# Altium schematic sheet GridSeed.SchDoc (part 1 of 2)
size A0; DocumentNumber: 1; SheetNumber: 1; SheetTotal: 1; SheetSize: A3
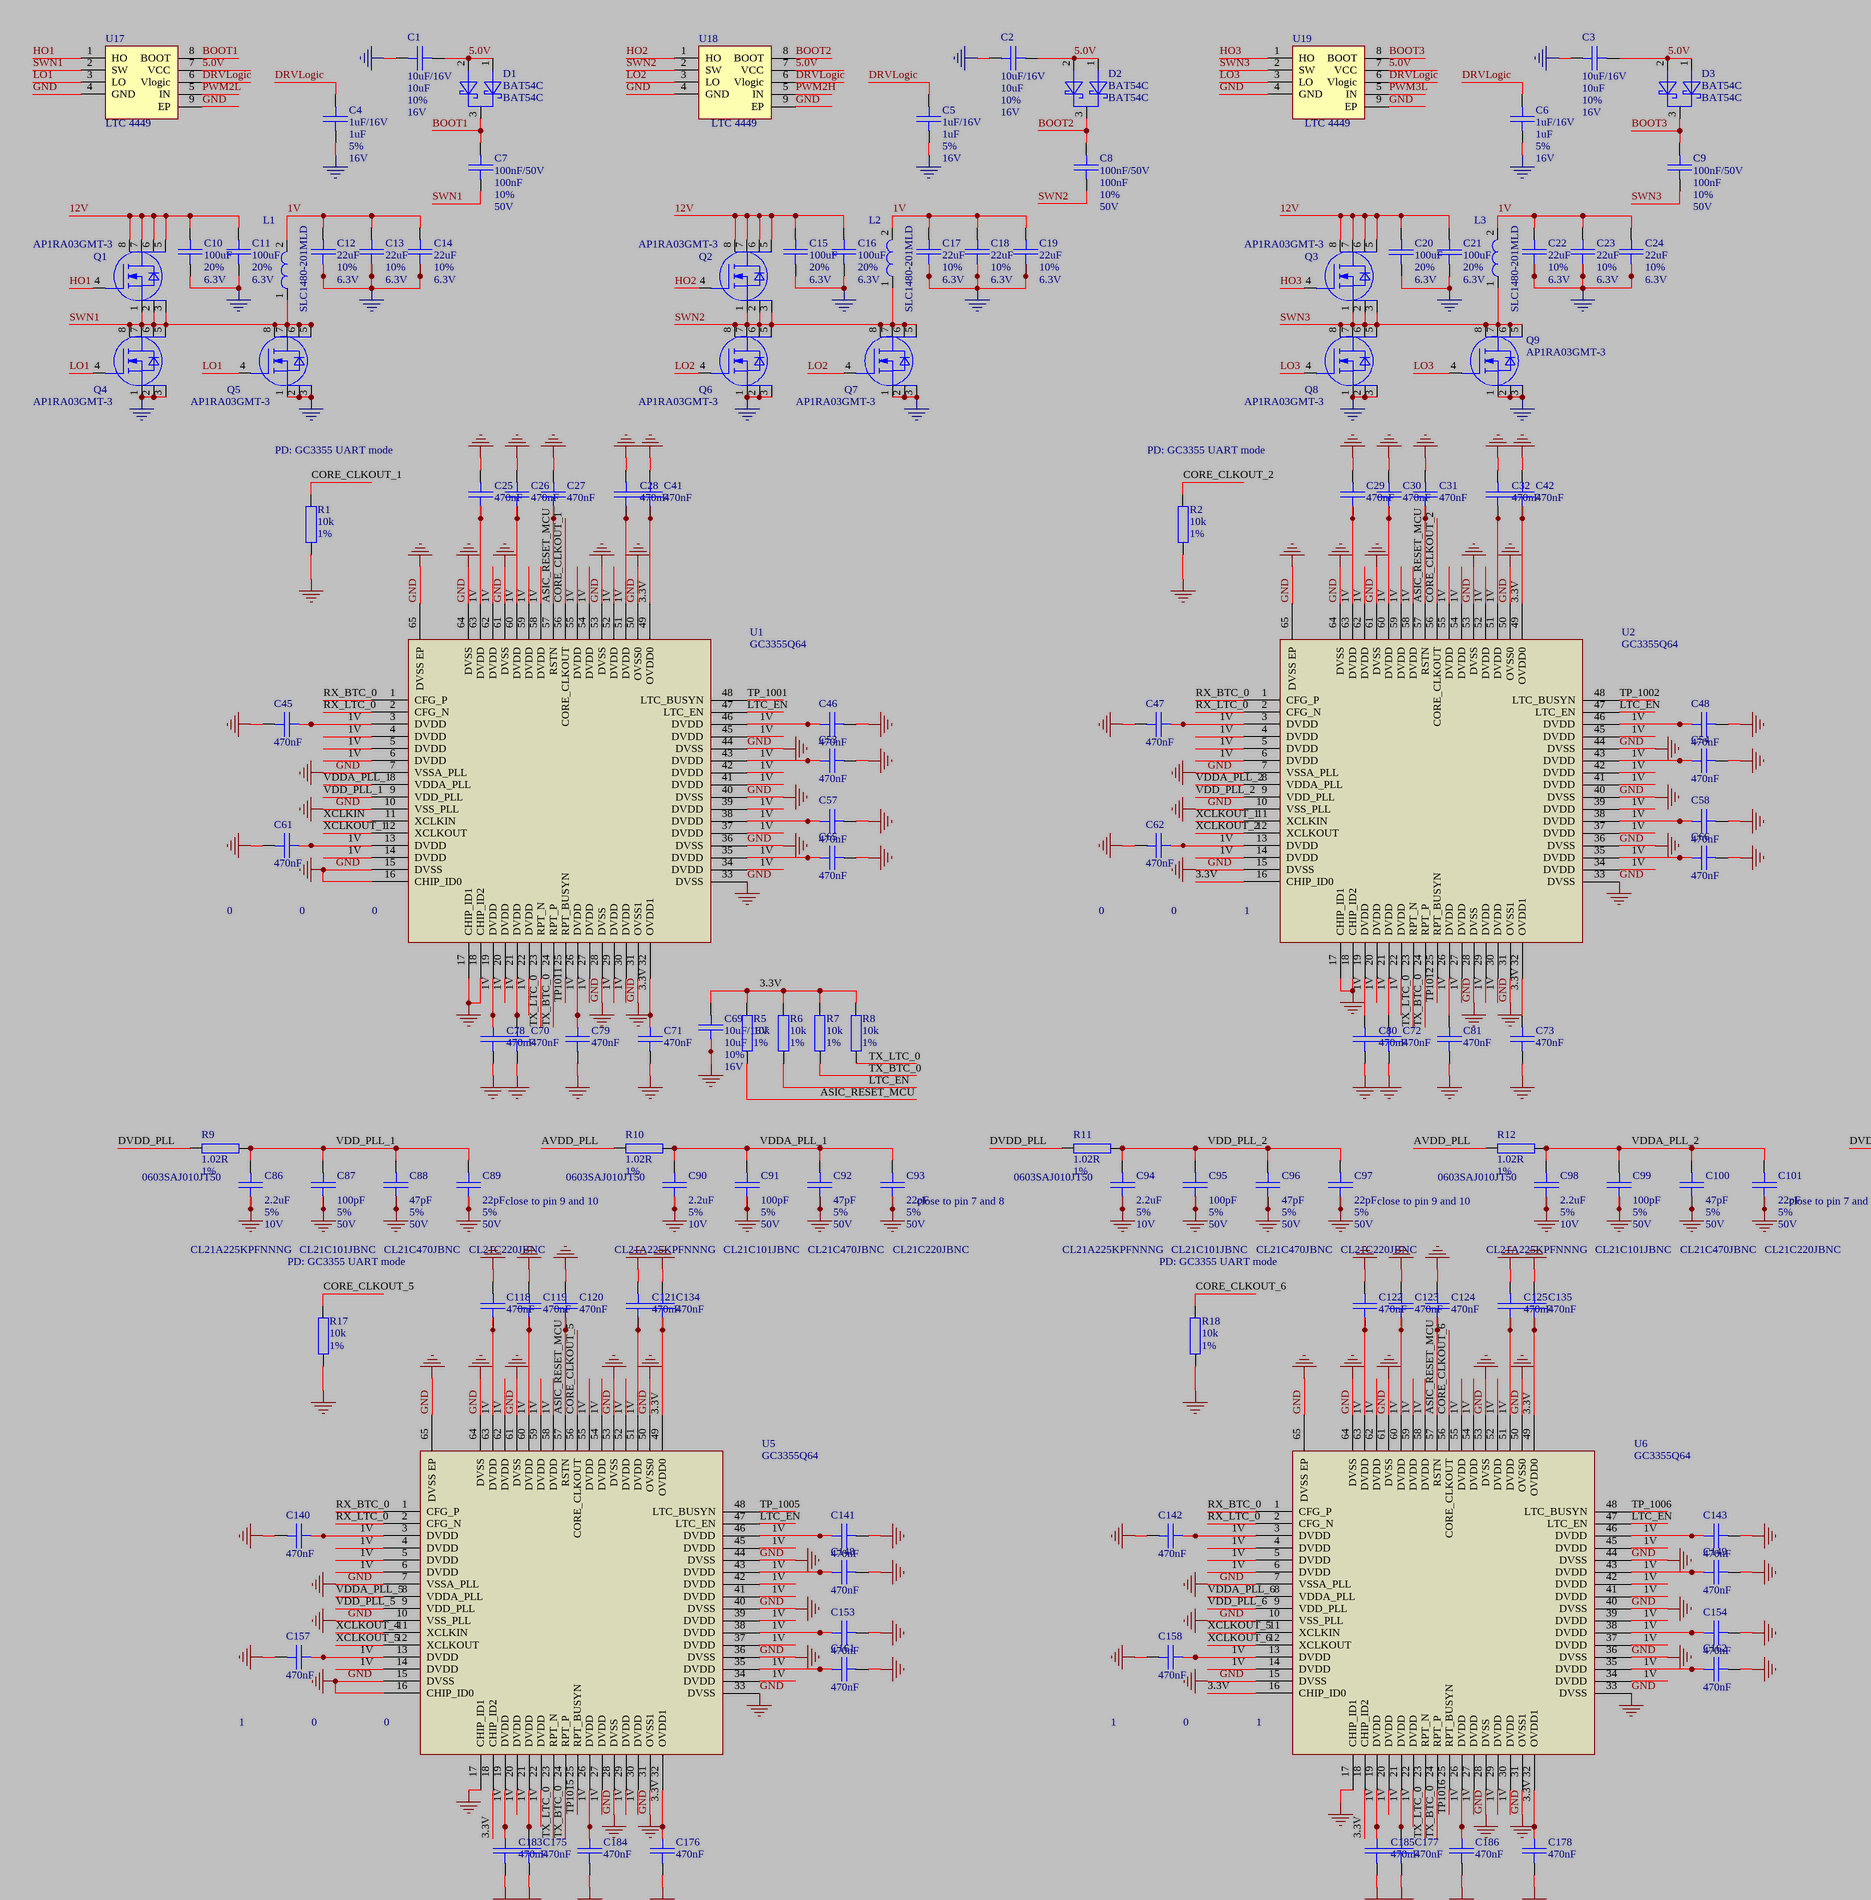
[diagram p0: GridSeed.SchDoc, top left]
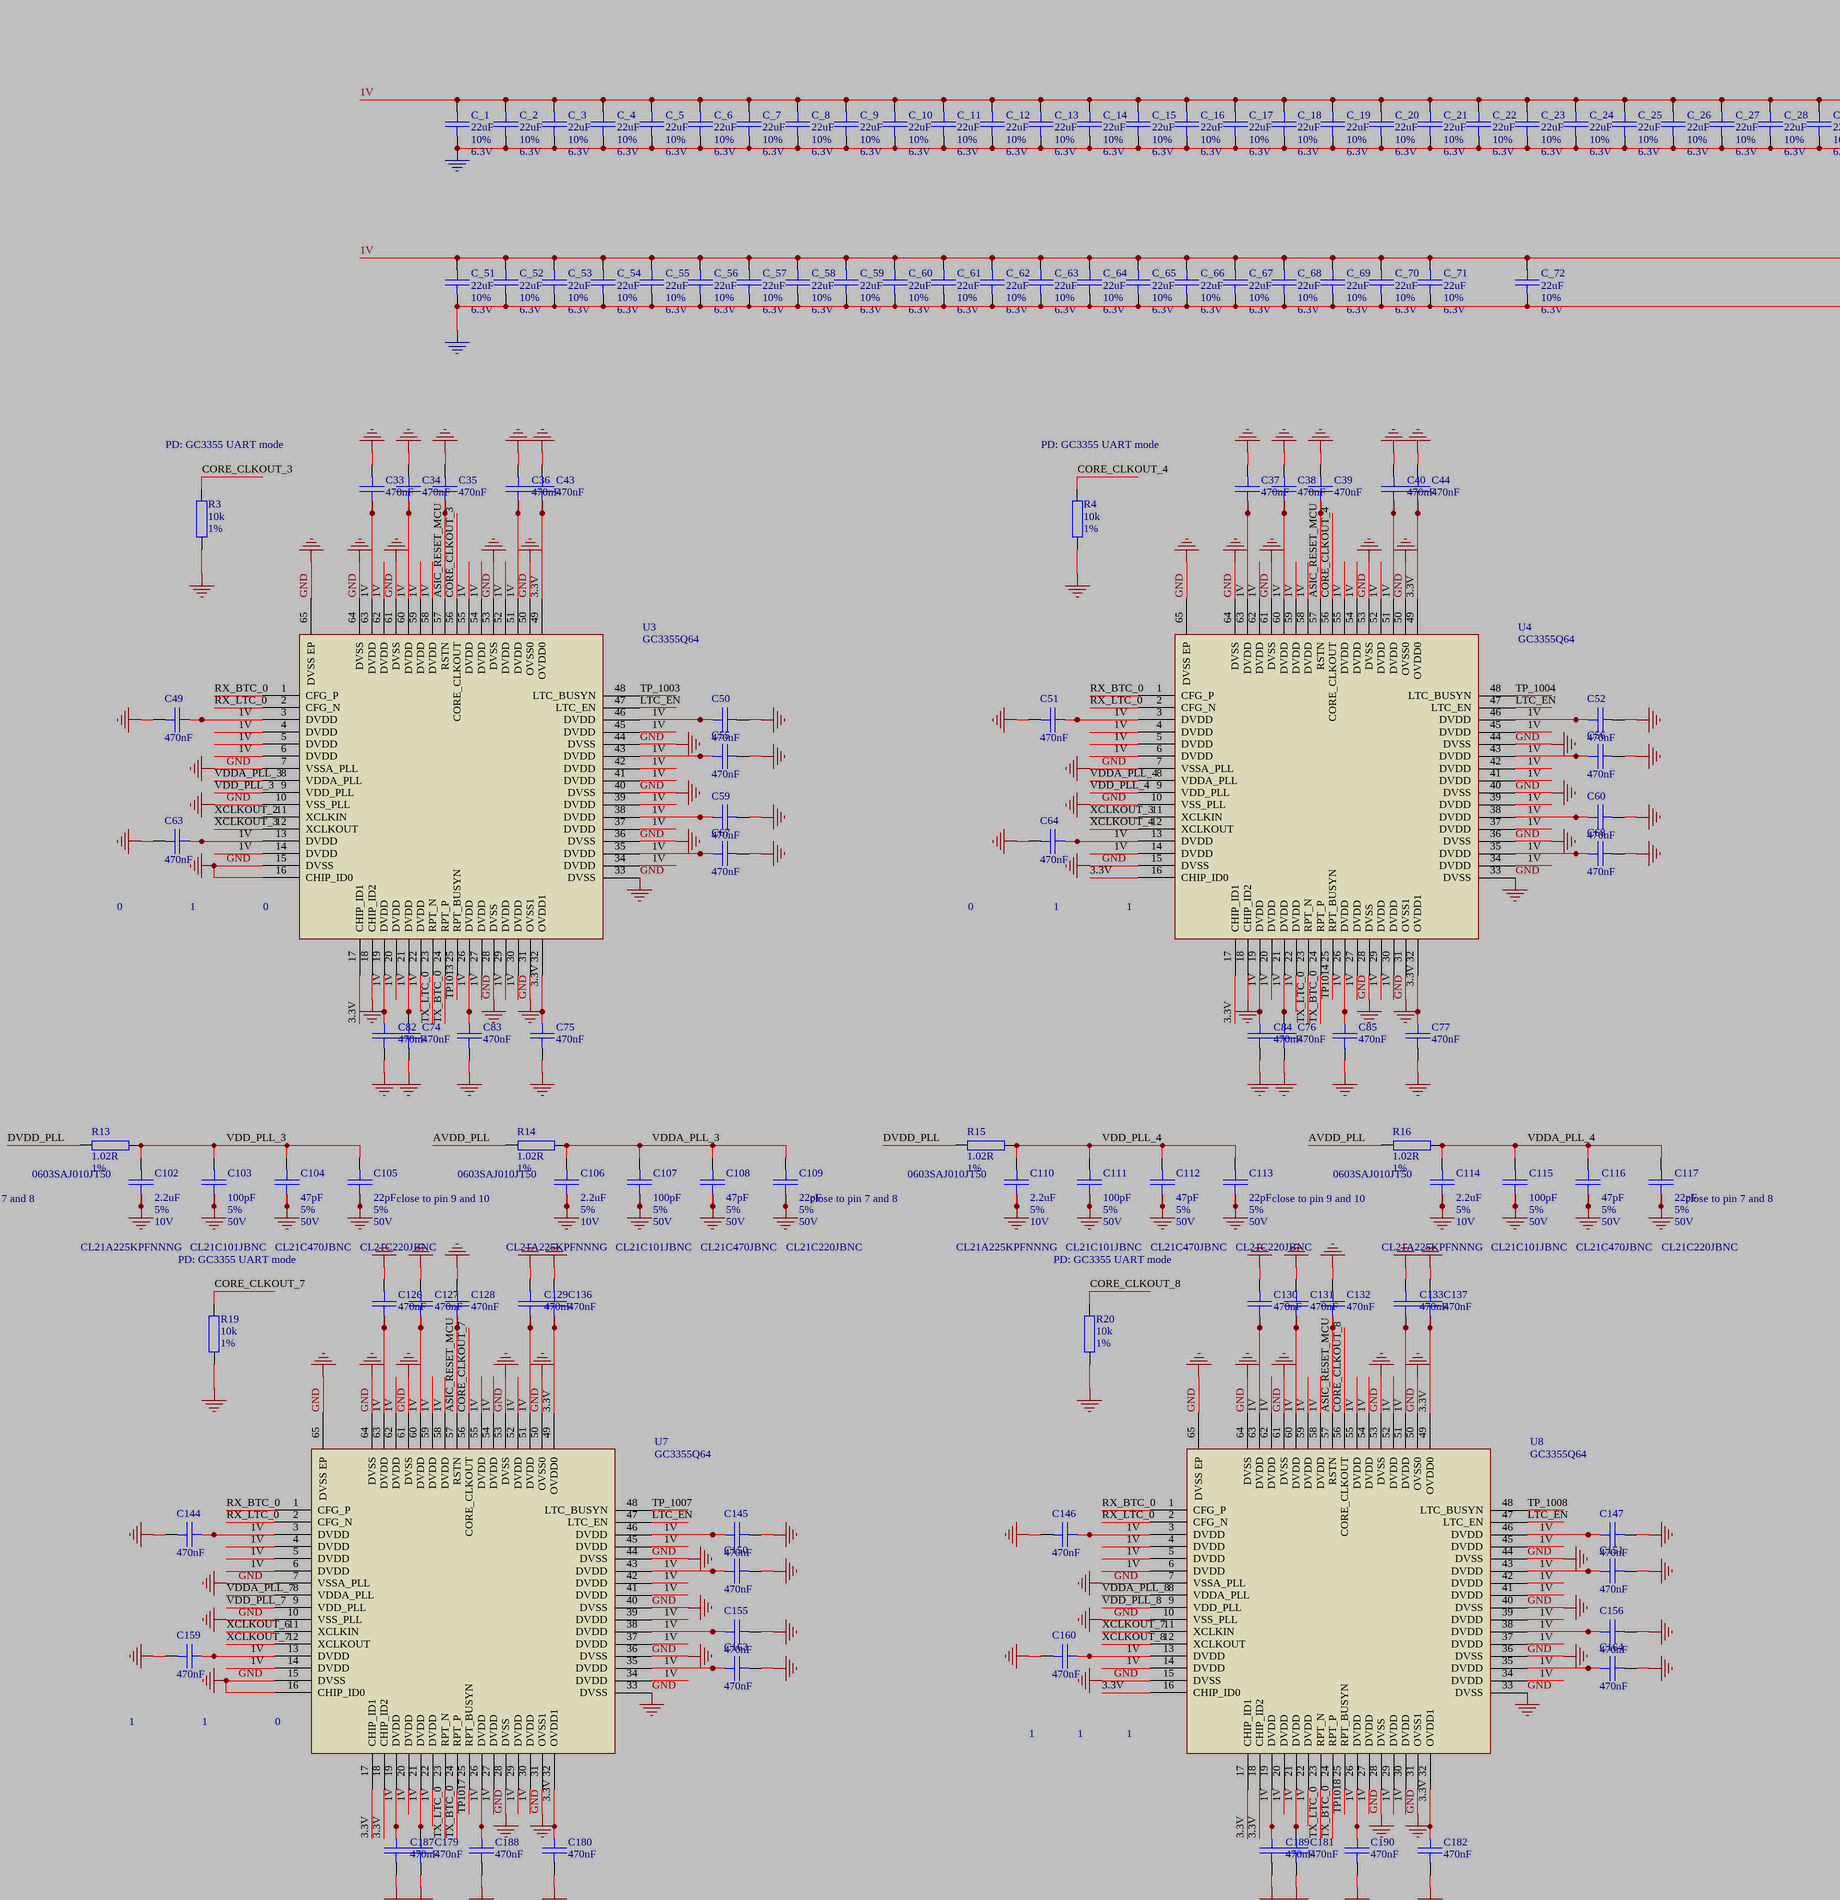
[diagram p1: GridSeed.SchDoc, top middle]
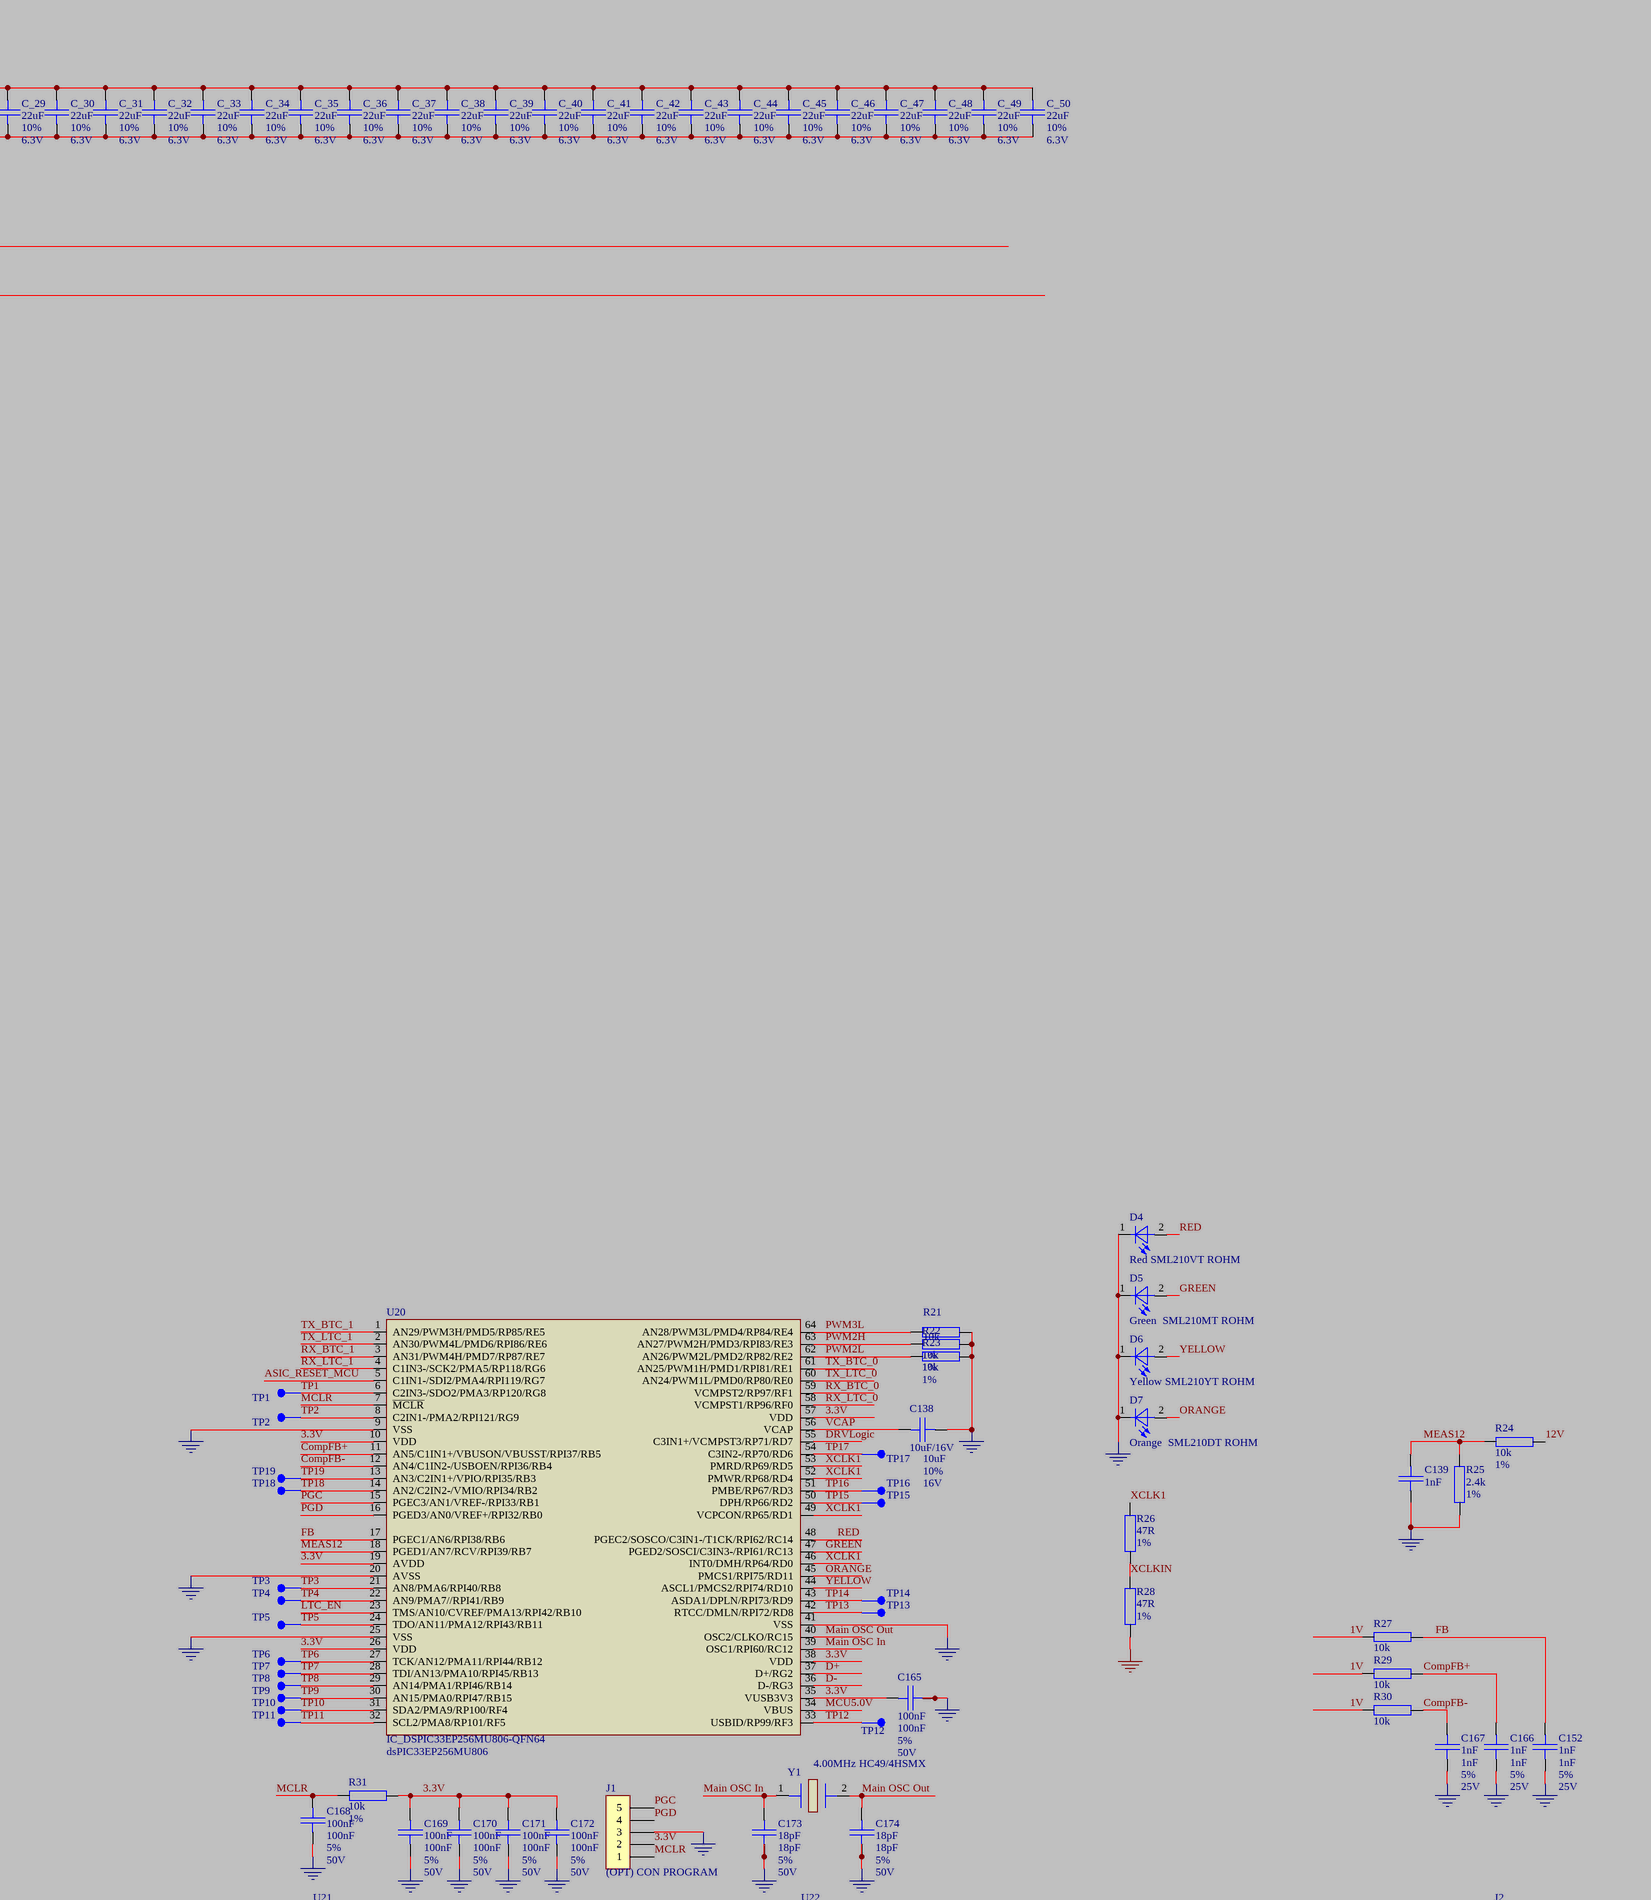
[diagram p2: GridSeed.SchDoc, top right]
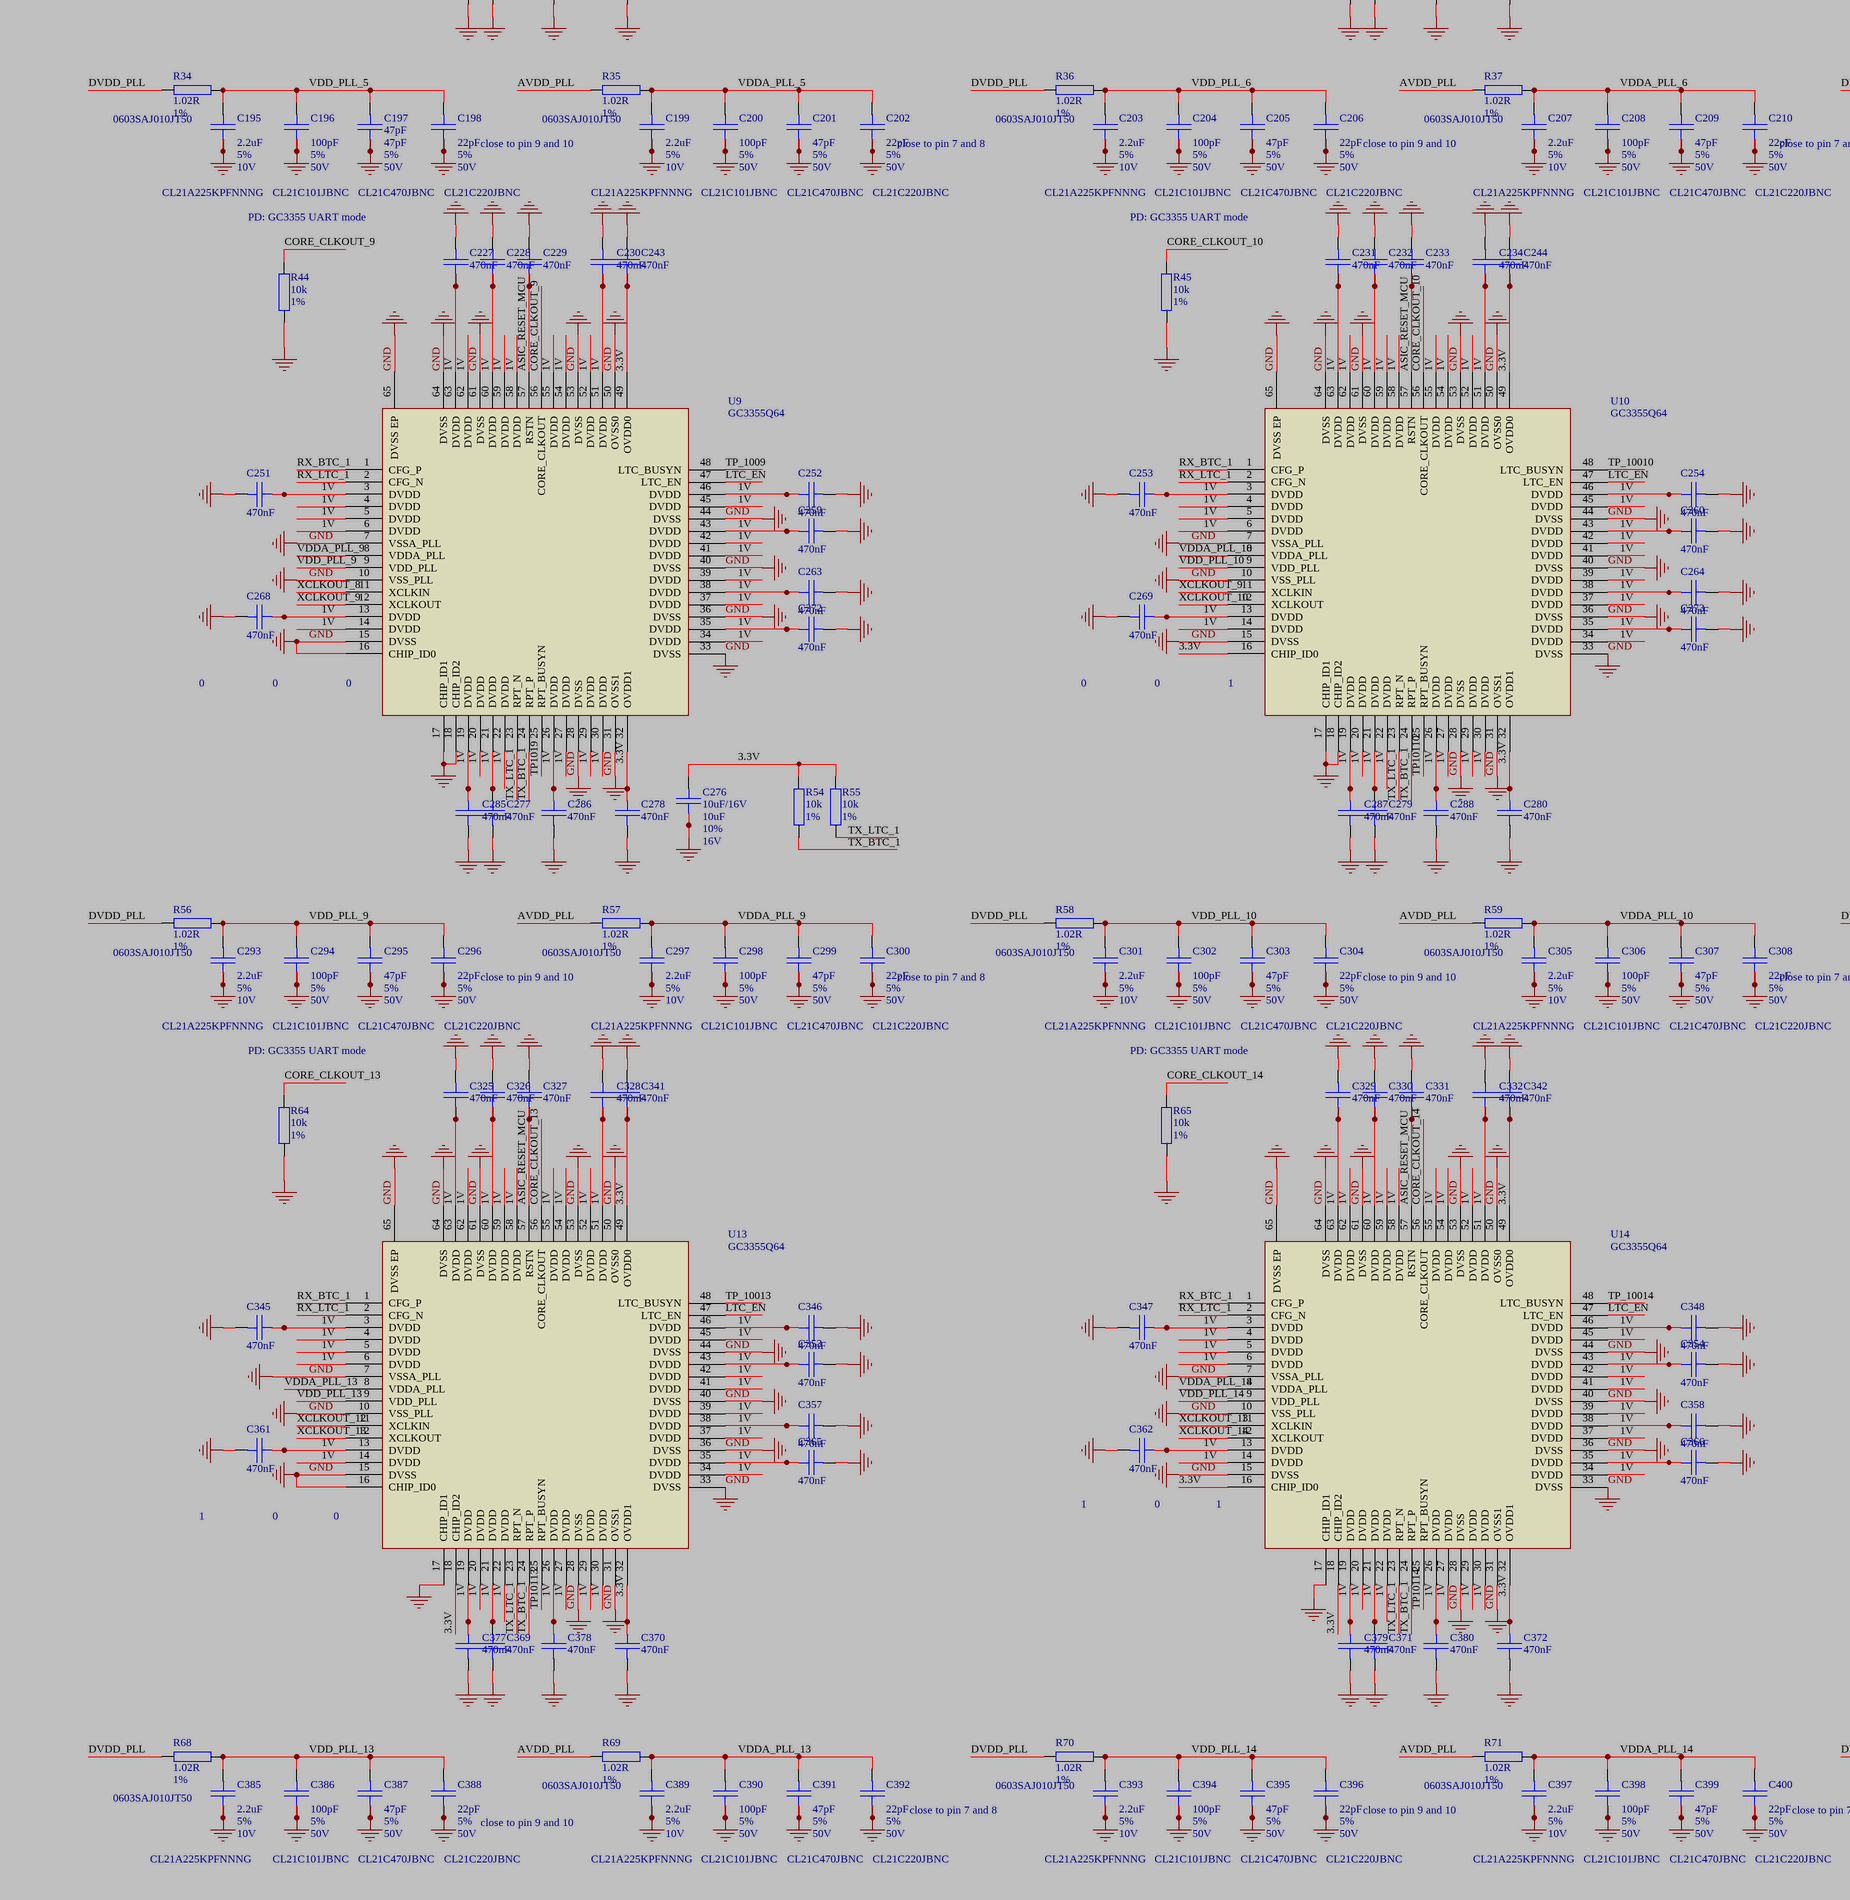
[diagram p3: GridSeed.SchDoc, bottom left]
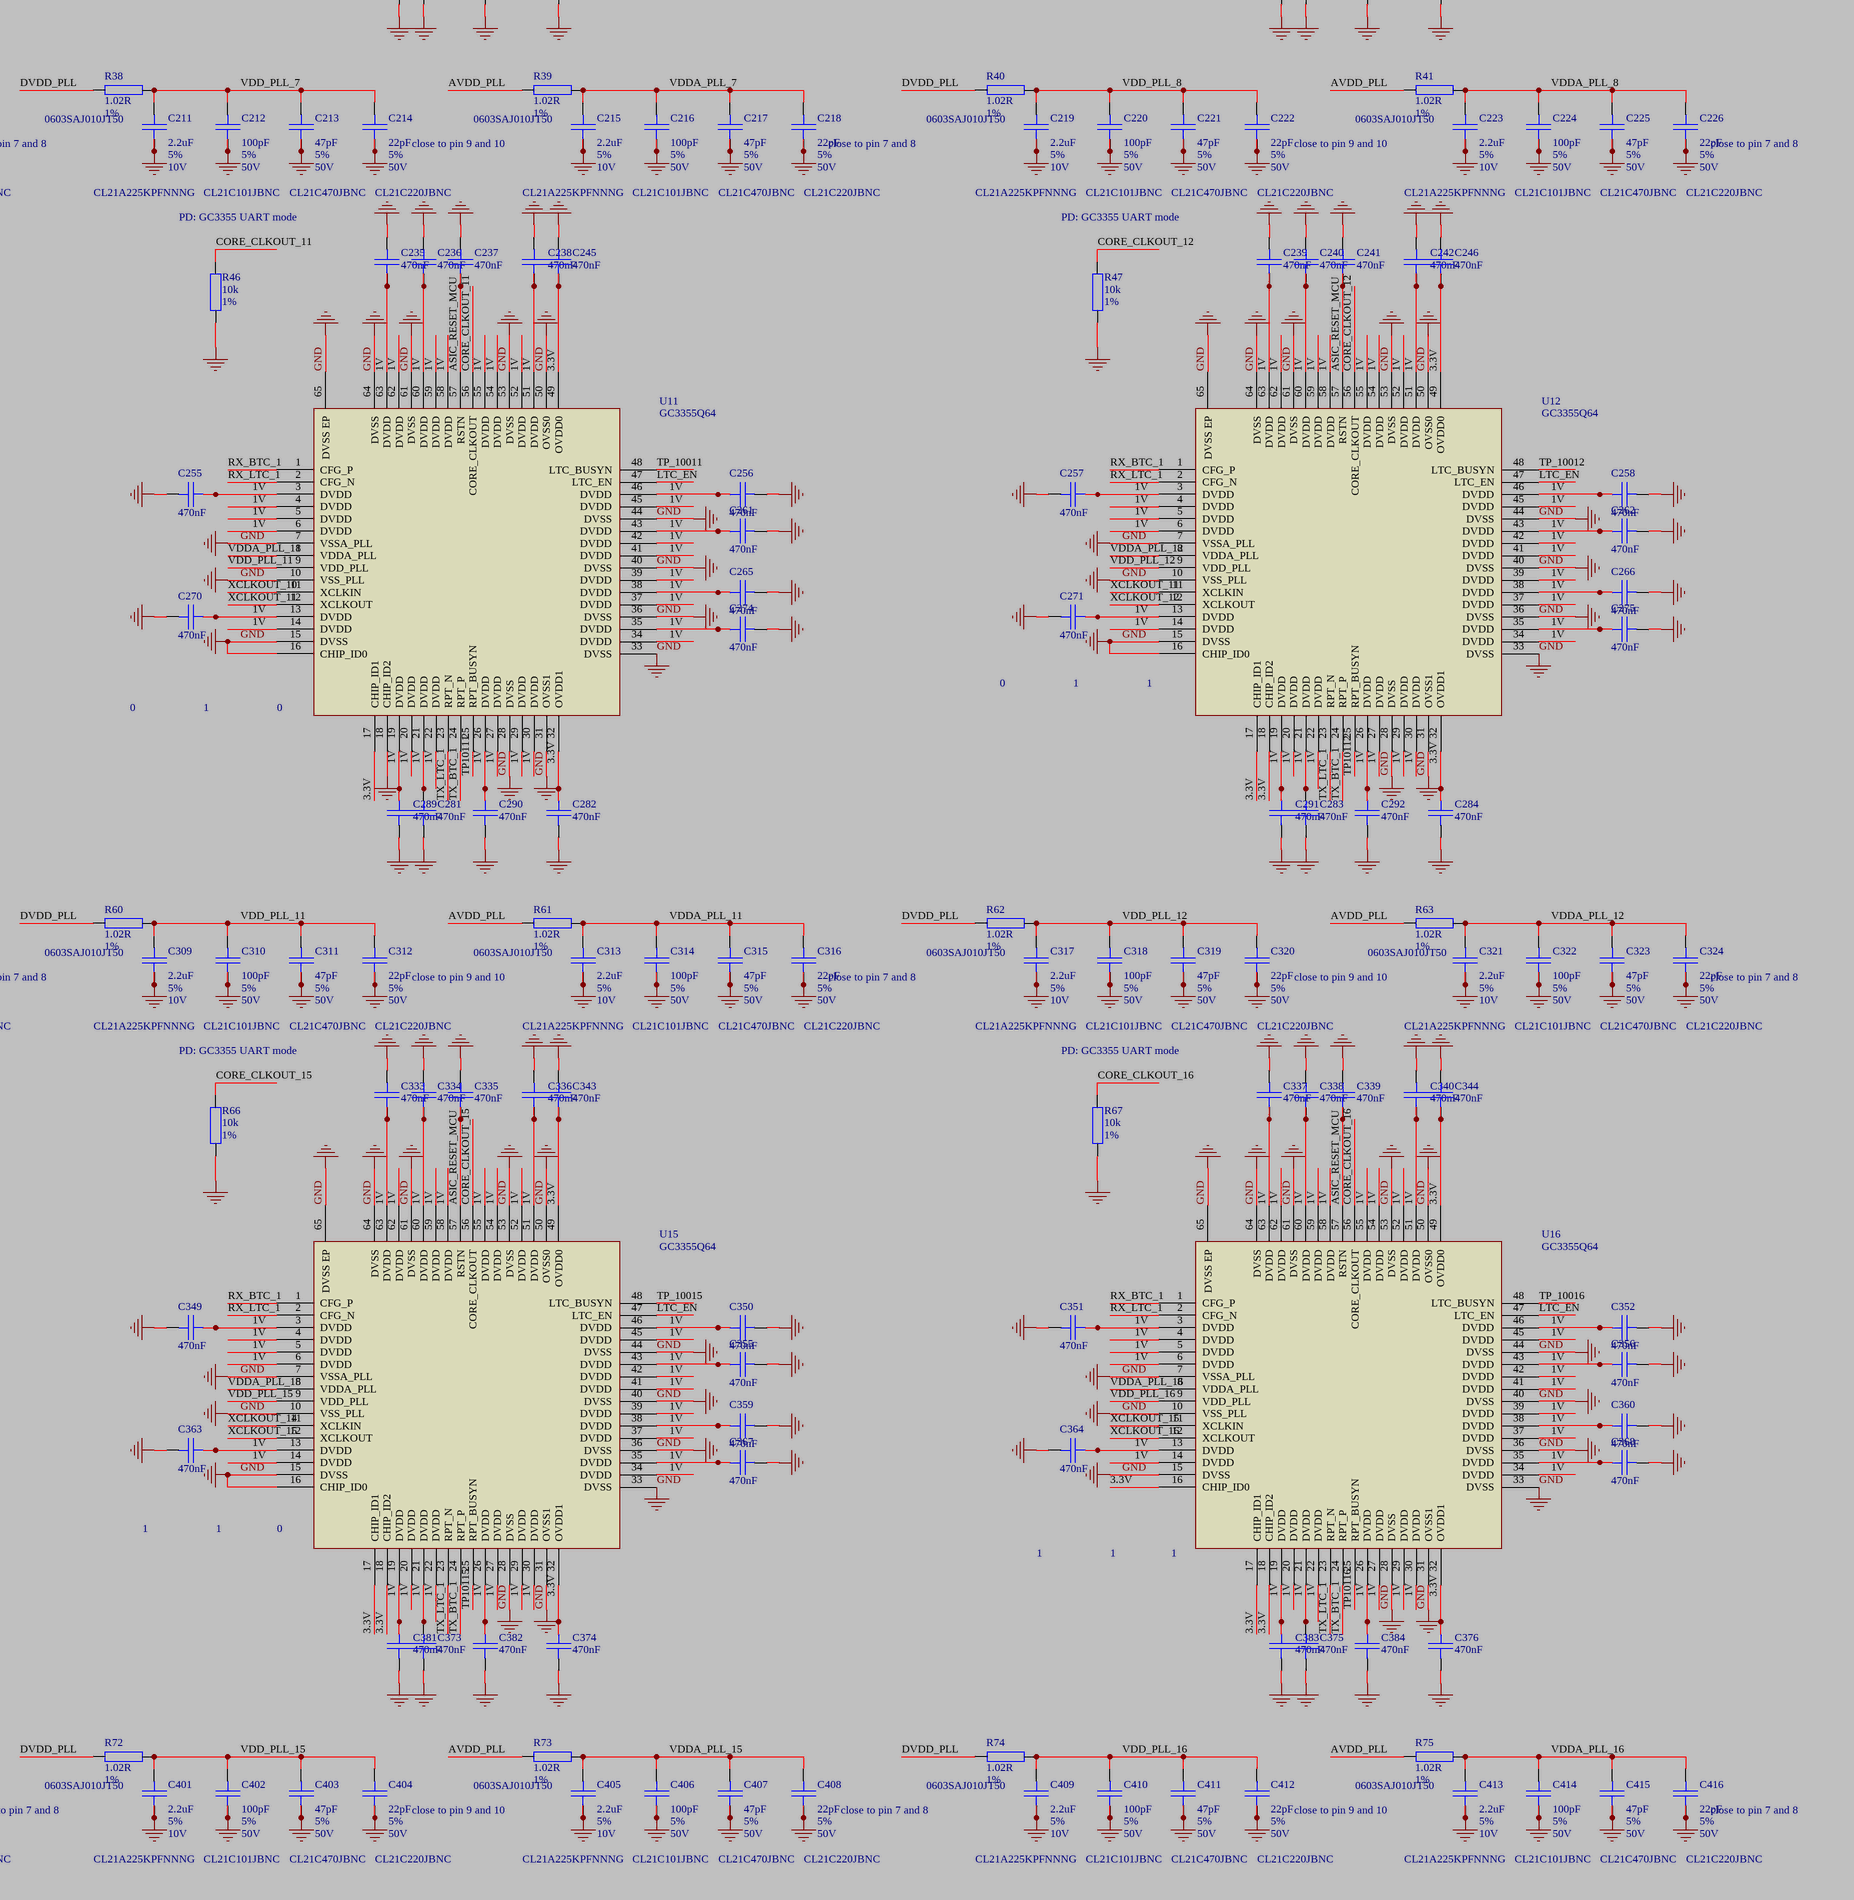
[diagram p4: GridSeed.SchDoc, bottom middle]
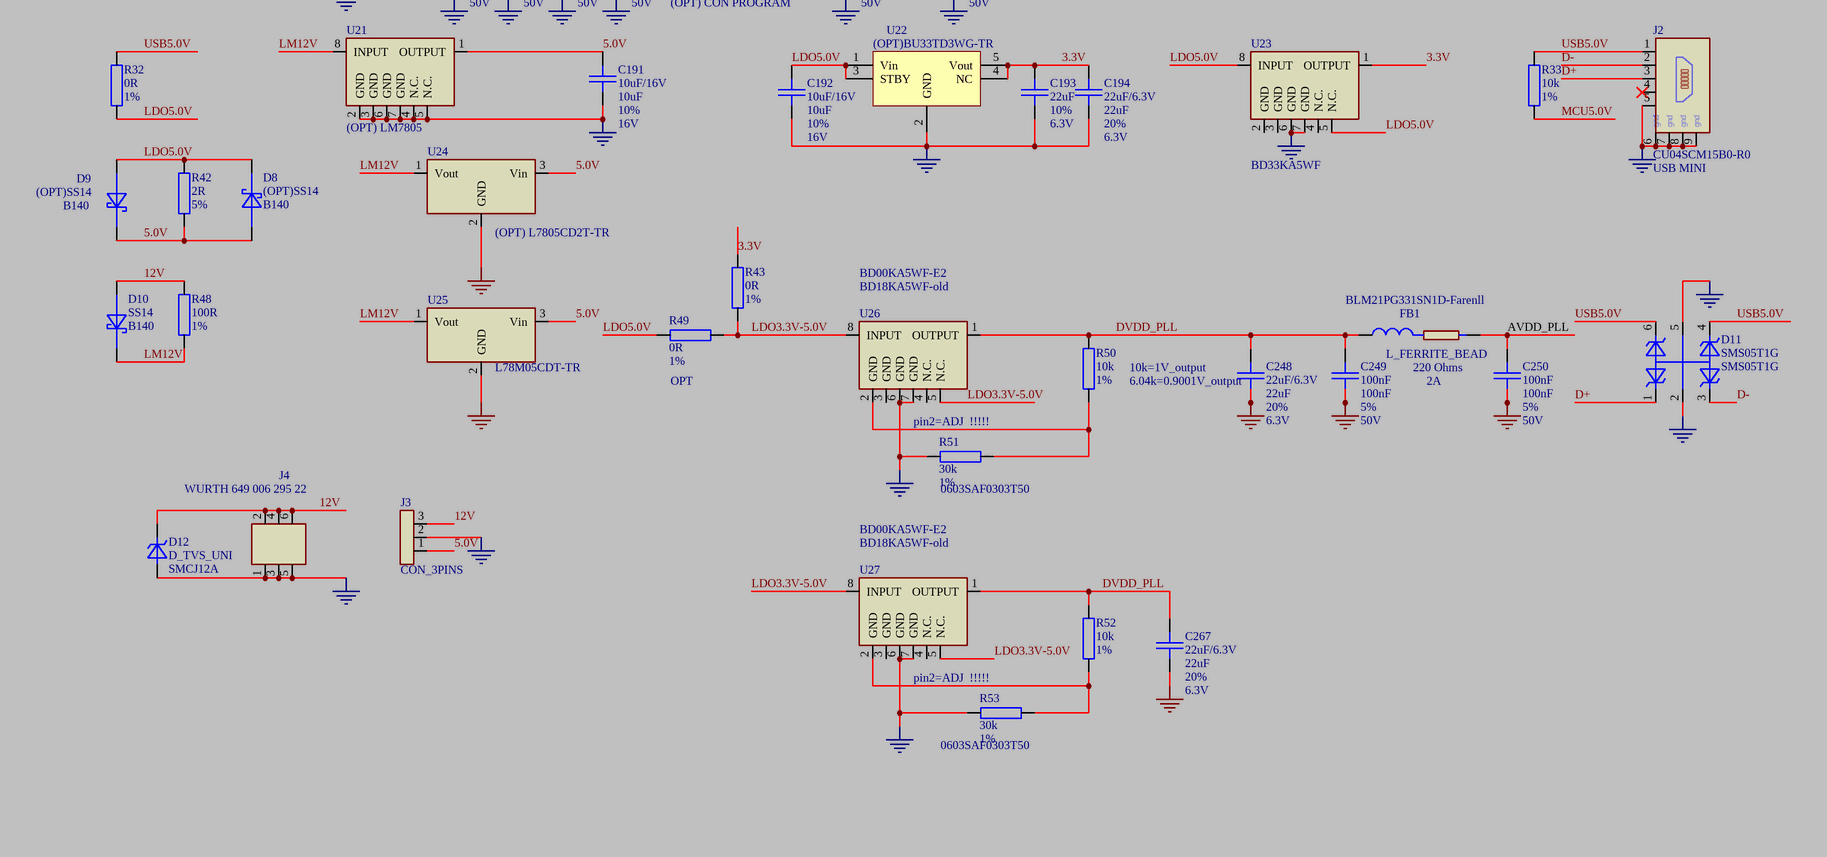
[diagram p5: GridSeed.SchDoc, bottom right]

## Parts
C1  10uF/16V  DB_VALUE: 10uF  DB_TOLERANCE: 10%  DB_VOLTAGE: 16V  [SMD_0805_CAPC2012X145N]
C2  10uF/16V  DB_VALUE: 10uF  DB_TOLERANCE: 10%  DB_VOLTAGE: 16V  [SMD_0805_CAPC2012X145N]
C3  10uF/16V  DB_VALUE: 10uF  DB_TOLERANCE: 10%  DB_VOLTAGE: 16V  [SMD_0805_CAPC2012X145N]
C4  1uF/16V  DB_VALUE: 1uF  DB_TOLERANCE: 5%  DB_VOLTAGE: 16V  [SMD_0805_CAPC2012X145N]
C5  1uF/16V  DB_VALUE: 1uF  DB_TOLERANCE: 5%  DB_VOLTAGE: 16V  [SMD_0805_CAPC2012X145N]
C6  1uF/16V  DB_VALUE: 1uF  DB_TOLERANCE: 5%  DB_VOLTAGE: 16V  [SMD_0805_CAPC2012X145N]
C7  100nF/50V  DB_VALUE: 100nF  DB_TOLERANCE: 10%  DB_VOLTAGE: 50V  [SMD_0805_CAPC2012X145N]
C8  100nF/50V  DB_VALUE: 100nF  DB_TOLERANCE: 10%  DB_VOLTAGE: 50V  [SMD_0805_CAPC2012X145N]
C9  100nF/50V  DB_VALUE: 100nF  DB_TOLERANCE: 10%  DB_VOLTAGE: 50V  [SMD_0805_CAPC2012X145N]
C10  DB_VALUE: 100uF  DB_TOLERANCE: 20%  DB_VOLTAGE: 6.3V  [SMD_1210_CAPC3225X270N]
C11  DB_VALUE: 100uF  DB_TOLERANCE: 20%  DB_VOLTAGE: 6.3V  [SMD_1210_CAPC3225X270N]
C12  DB_VALUE: 22uF  DB_TOLERANCE: 10%  DB_VOLTAGE: 6.3V  [SMD_1210_CAPC3225X270N]
C13  DB_VALUE: 22uF  DB_TOLERANCE: 10%  DB_VOLTAGE: 6.3V  [SMD_1210_CAPC3225X270N]
C14  DB_VALUE: 22uF  DB_TOLERANCE: 10%  DB_VOLTAGE: 6.3V  [SMD_1210_CAPC3225X270N]
C15  DB_VALUE: 100uF  DB_TOLERANCE: 20%  DB_VOLTAGE: 6.3V  [SMD_1210_CAPC3225X270N]
C16  DB_VALUE: 100uF  DB_TOLERANCE: 20%  DB_VOLTAGE: 6.3V  [SMD_1210_CAPC3225X270N]
C17  DB_VALUE: 22uF  DB_TOLERANCE: 10%  DB_VOLTAGE: 6.3V  [SMD_1210_CAPC3225X270N]
C18  DB_VALUE: 22uF  DB_TOLERANCE: 10%  DB_VOLTAGE: 6.3V  [SMD_1210_CAPC3225X270N]
C19  DB_VALUE: 22uF  DB_TOLERANCE: 10%  DB_VOLTAGE: 6.3V  [SMD_1210_CAPC3225X270N]
C20  DB_VALUE: 100uF  DB_TOLERANCE: 20%  DB_VOLTAGE: 6.3V  [SMD_1210_CAPC3225X270N]
C21  DB_VALUE: 100uF  DB_TOLERANCE: 20%  DB_VOLTAGE: 6.3V  [SMD_1210_CAPC3225X270N]
C22  DB_VALUE: 22uF  DB_TOLERANCE: 10%  DB_VOLTAGE: 6.3V  [SMD_1210_CAPC3225X270N]
C23  DB_VALUE: 22uF  DB_TOLERANCE: 10%  DB_VOLTAGE: 6.3V  [SMD_1210_CAPC3225X270N]
C24  DB_VALUE: 22uF  DB_TOLERANCE: 10%  DB_VOLTAGE: 6.3V  [SMD_1210_CAPC3225X270N]
C25  DB_VALUE: 470nF  [SMD_0603_CAPC1608X95N]
C26  DB_VALUE: 470nF  [SMD_0603_CAPC1608X95N]
C27  DB_VALUE: 470nF  [SMD_0603_CAPC1608X95N]
C28  DB_VALUE: 470nF  [SMD_0603_CAPC1608X95N]
C29  DB_VALUE: 470nF  [SMD_0603_CAPC1608X95N]
C30  DB_VALUE: 470nF  [SMD_0603_CAPC1608X95N]
C31  DB_VALUE: 470nF  [SMD_0603_CAPC1608X95N]
C32  DB_VALUE: 470nF  [SMD_0603_CAPC1608X95N]
C33  DB_VALUE: 470nF  [SMD_0603_CAPC1608X95N]
C34  DB_VALUE: 470nF  [SMD_0603_CAPC1608X95N]
C35  DB_VALUE: 470nF  [SMD_0603_CAPC1608X95N]
C36  DB_VALUE: 470nF  [SMD_0603_CAPC1608X95N]
C37  DB_VALUE: 470nF  [SMD_0603_CAPC1608X95N]
C38  DB_VALUE: 470nF  [SMD_0603_CAPC1608X95N]
C39  DB_VALUE: 470nF  [SMD_0603_CAPC1608X95N]
C40  DB_VALUE: 470nF  [SMD_0603_CAPC1608X95N]
C41  DB_VALUE: 470nF  [SMD_0603_CAPC1608X95N]
C42  DB_VALUE: 470nF  [SMD_0603_CAPC1608X95N]
C43  DB_VALUE: 470nF  [SMD_0603_CAPC1608X95N]
C44  DB_VALUE: 470nF  [SMD_0603_CAPC1608X95N]
C45  DB_VALUE: 470nF  [SMD_0603_CAPC1608X95N]
C46  DB_VALUE: 470nF  [SMD_0603_CAPC1608X95N]
C47  DB_VALUE: 470nF  [SMD_0603_CAPC1608X95N]
C48  DB_VALUE: 470nF  [SMD_0603_CAPC1608X95N]
C49  DB_VALUE: 470nF  [SMD_0603_CAPC1608X95N]
C50  DB_VALUE: 470nF  [SMD_0603_CAPC1608X95N]
C51  DB_VALUE: 470nF  [SMD_0603_CAPC1608X95N]
C52  DB_VALUE: 470nF  [SMD_0603_CAPC1608X95N]
C53  DB_VALUE: 470nF  [SMD_0603_CAPC1608X95N]
C54  DB_VALUE: 470nF  [SMD_0603_CAPC1608X95N]
C55  DB_VALUE: 470nF  [SMD_0603_CAPC1608X95N]
C56  DB_VALUE: 470nF  [SMD_0603_CAPC1608X95N]
C57  DB_VALUE: 470nF  [SMD_0603_CAPC1608X95N]
C58  DB_VALUE: 470nF  [SMD_0603_CAPC1608X95N]
C59  DB_VALUE: 470nF  [SMD_0603_CAPC1608X95N]
C60  DB_VALUE: 470nF  [SMD_0603_CAPC1608X95N]
C61  DB_VALUE: 470nF  [SMD_0603_CAPC1608X95N]
C62  DB_VALUE: 470nF  [SMD_0603_CAPC1608X95N]
C63  DB_VALUE: 470nF  [SMD_0603_CAPC1608X95N]
C64  DB_VALUE: 470nF  [SMD_0603_CAPC1608X95N]
C65  DB_VALUE: 470nF  [SMD_0603_CAPC1608X95N]
C66  DB_VALUE: 470nF  [SMD_0603_CAPC1608X95N]
C67  DB_VALUE: 470nF  [SMD_0603_CAPC1608X95N]
C68  DB_VALUE: 470nF  [SMD_0603_CAPC1608X95N]
C69  10uF/16V  DB_VALUE: 10uF  DB_TOLERANCE: 10%  DB_VOLTAGE: 16V  [SMD_0805_CAPC2012X145N]
C70  DB_VALUE: 470nF  [SMD_0603_CAPC1608X95N]
C71  DB_VALUE: 470nF  [SMD_0603_CAPC1608X95N]
C72  DB_VALUE: 470nF  [SMD_0603_CAPC1608X95N]
C73  DB_VALUE: 470nF  [SMD_0603_CAPC1608X95N]